# EAGLE board Dragino Pan.v1.7 (EAGLE 7.5.0)
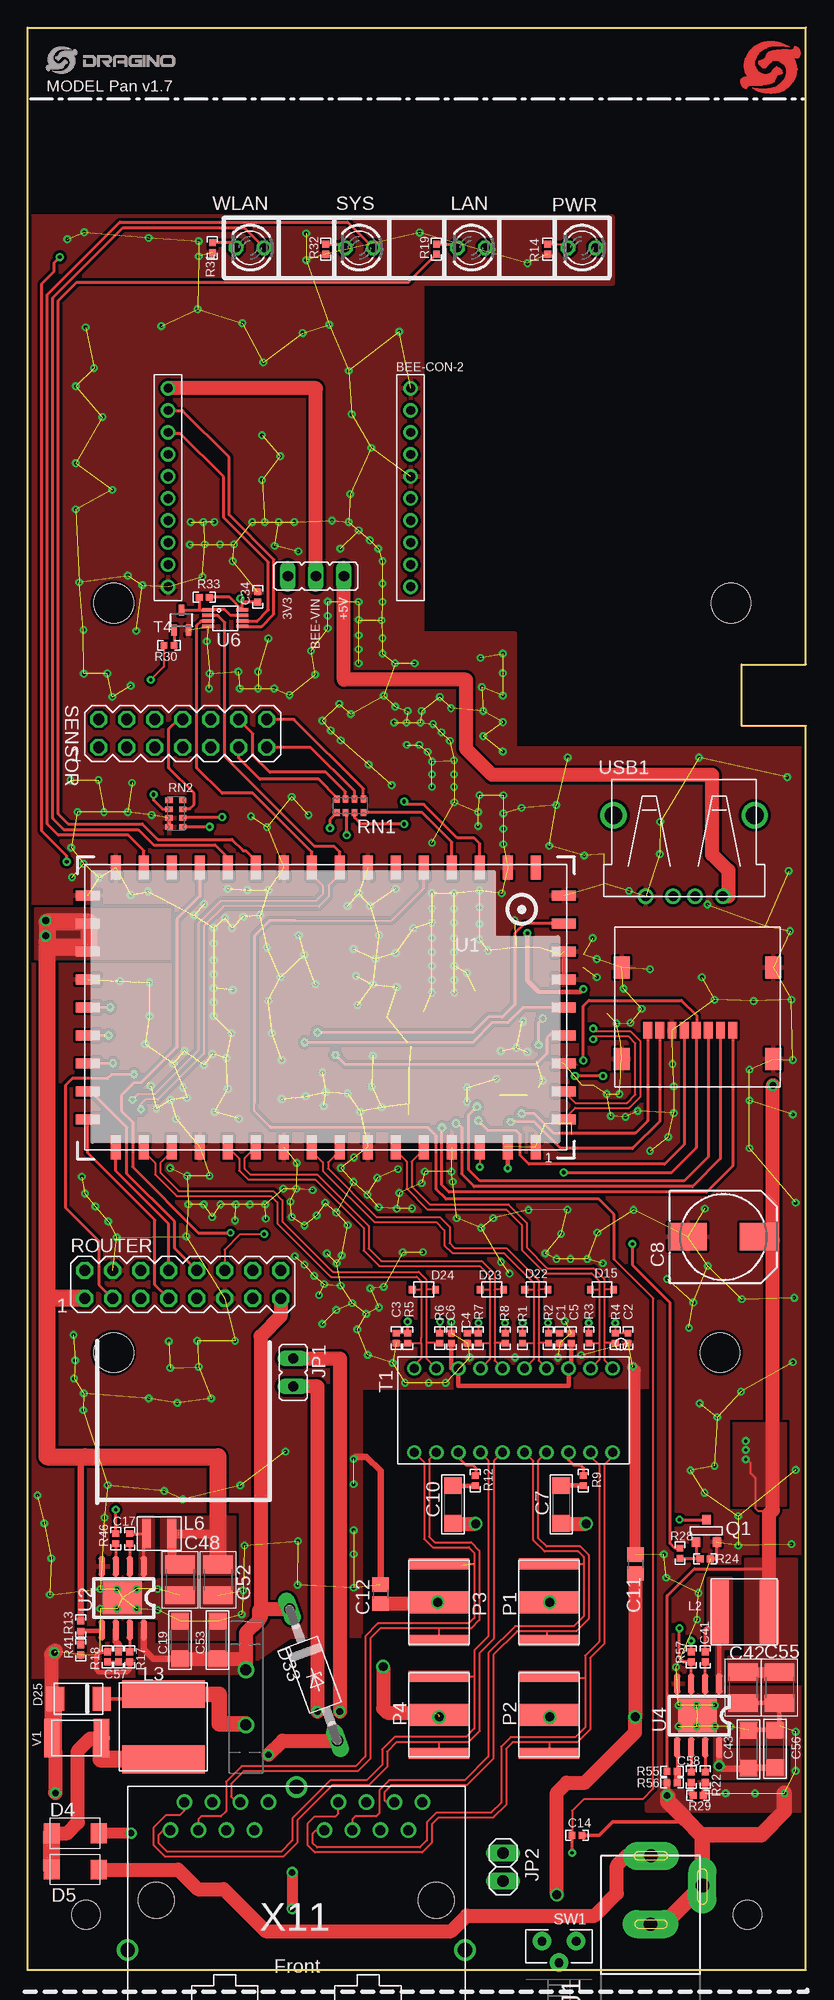
[diagram p6: board, top side]
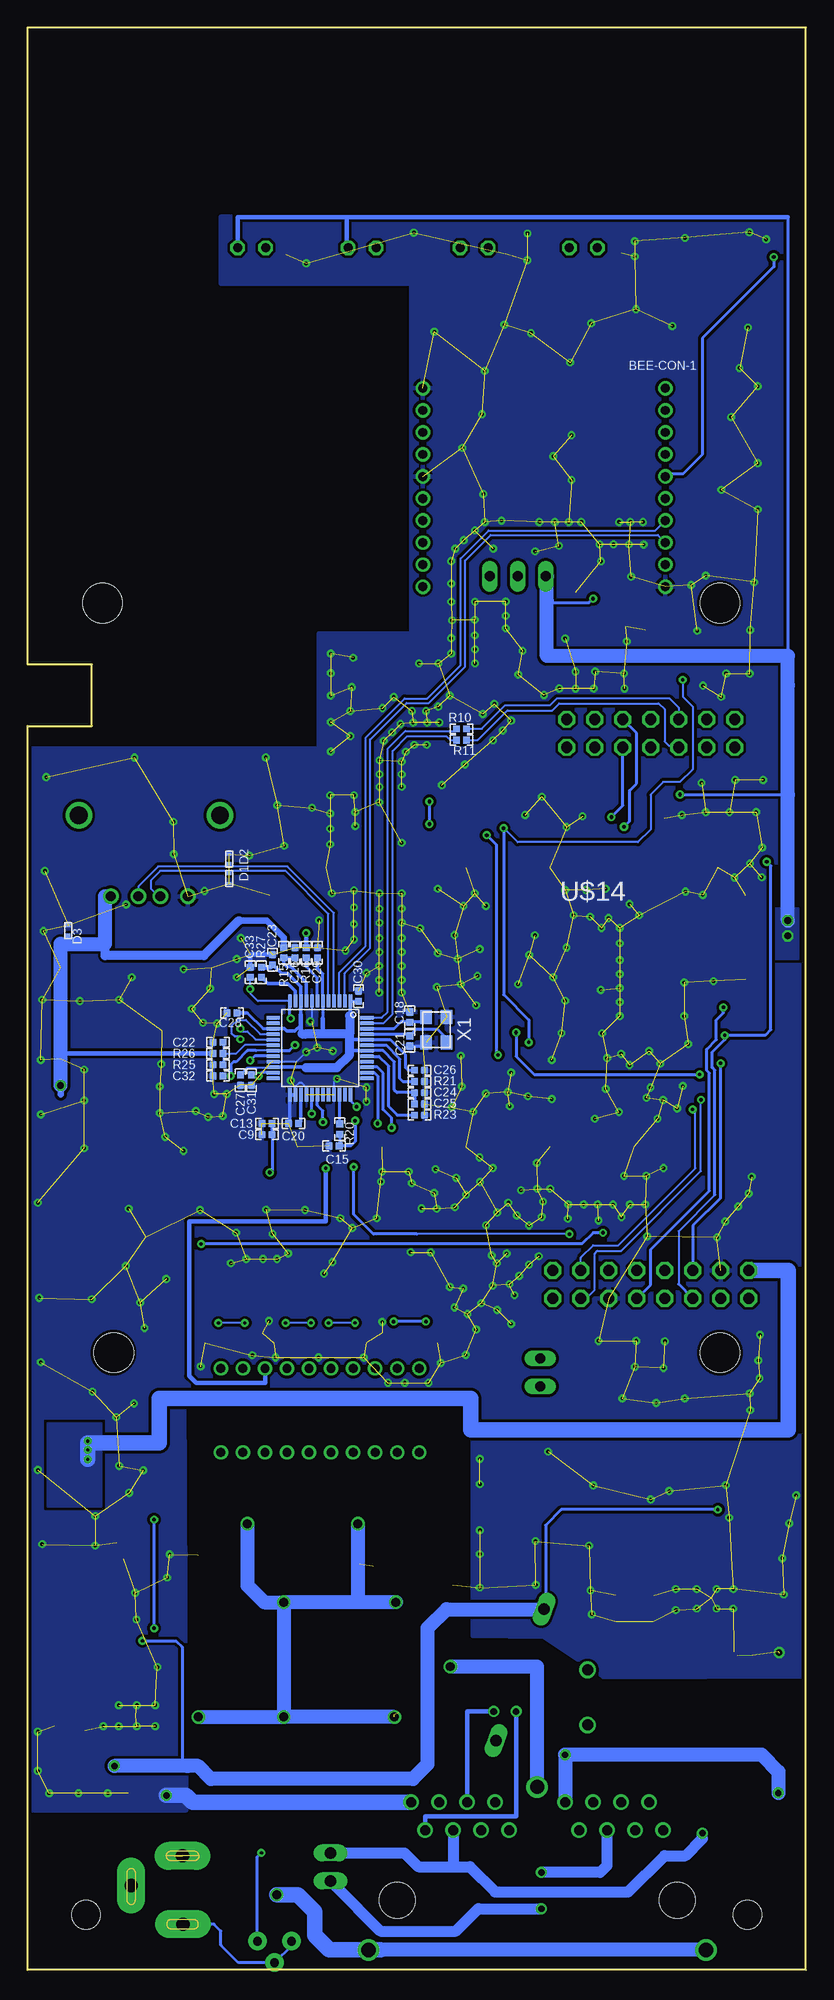
[diagram p7: board, bottom side, seen from below]

Size 70.61 x 176.23 mm. Coordinates in mm from the lower left corner, seen from the top.
Outline: 0,0 70.61,0 70.61,112.86 64.77,112.86 64.77,118.45 70.61,118.45 70.61,176.23 0,176.23 0,0
Copper layers (1*16): Top 0.035mm / dielectric 1.5mm / Bottom 0.035mm
Design rules "default *": minimum track width 8mil, minimum drill 12mil, track to track 8mil, track to pad 8mil, pad to pad 6mil, via to via 8mil, smd to smd 8mil, copper to edge 10mil, drill to drill 8mil, minimum pad ring 10mil, minimum via ring 8mil, stop-mask expansion 1mil, vias tented up to drill 30mil, thermal gap 10mil
Net classes: 0 default: width 0.203 mm, clearance 0.254 mm; 2 gnd: width 0.305 mm, drill 0.33 mm, clearance 0.254 mm; 3 usbvcc: width 0.254 mm, drill 0.61 mm, clearance 0.254 mm; 5 usbtrace: width 0.254 mm, clearance 0.152 mm; 6 usbtrace-4layer: width 0.191 mm, clearance 0.203 mm
Holes 3.6 mm at 62.81,56 7.81,56 63.81,124 7.81,124
Holes 2.6 mm at 65.31,5 5.31,5
tKeepout: area 4.8,53 to 10.8,59; area 59.8,53 to 65.8,59; area 60.8,121 to 66.8,127; area 4.8,121 to 10.8,127

## Footprints (pad centres in the part's own frame; a part is rotated, then mirrored left to right if it is on the bottom)
10P-2.0MM = drill 0.8 pad 1.27: 1 0,9; 2 0,7; 3 0,5; 4 0,3; 5 0,1; 6 0,-1; 7 0,-3; 8 0,-5; 9 0,-7; 10 0,-9
JP2 = drill 0.914 long: 1 -2.54,0; 2 0,0; 3 2.54,0
C0402 = smd 0.61 x 0.61: 1 -0.457,0; 2 0.457,0
C1206 = smd 1.52 x 1.6: 1 -1.71,0; 2 1.71,0
140CLH-0810 = smd 3.5 x 2.5: + 3.25,0; - -3.25,0
C0805 = smd 1.3 x 1.5: 1 -0.85,0; 2 0.85,0
C1210 = smd 1.6 x 2.7: 1 -1.4,0; 2 1.4,0
SOD−923 = smd 0.3 x 0.4: P$1 -0.45,0; P$2 0.45,0
DO214AC = smd 1.45 x 1.8: A 2.13,0; C -2.13,0
SOD−323 = smd 0.6 x 0.7: P$1 -1.05,0; P$2 1.05,0
DO-214AA = smd 1.62 x 2.18: A 2.11,0; C -2.11,0
F126Z12 = drill 1.016 long: A 6.35,0; C -6.35,0
GR72-135 = drill 1: P$1 -2.5,0; P$2 2.5,0
POWER_JACK_SLOT = drill 1.2 pad 2.54 long: GND@1 0,0; GND@2 4.7,3.5; PWR 0.04,6.2
JP1 = drill 0.914 long: 1 0,-1.27; 2 0,1.27
1X02 = drill 1.016 long: 1 -1.27,0; 2 1.27,0
SWPA6028S = smd 5.7 x 1.7: P$1 0,2.25; P$2 0,-2.25
LVS808040 = smd 2.5 x 7.5: P$1 -2.95,0; P$2 2.95,0
SWPA3010S = smd 0.8 x 2.7: P$1 -1.15,0; P$2 1.15,0
LED3MM = drill 0.813 octagon: A -1.27,0; K 1.27,0
GDT-LT-B3D090L = smd 1 x 5.5: 1 -3.48,0; 3 3.48,0 | smd 2 x 5.5: 2 0,0
SOT-23 = smd 0.787 x 0.889: 1 0,-1.016; 2 -0.95,1.016; 3 0.95,1.016
R0402 = smd 0.61 x 0.61: 1 -0.457,0; 2 0.457,0
0603-ARC = smd 0.5 x 0.65: 1 -1.2,-0.625; 2 -0.4,-0.625; 3 0.4,-0.625; 4 1.2,-0.625; 5 1.2,0.625; 6 0.4,0.625; 7 -0.4,0.625; 8 -1.2,0.625
MA08-2 = drill 1.016 octagon: 1 -8.89,-1.27; 2 -8.89,1.27; 3 -6.35,-1.27; 4 -6.35,1.27; 5 -3.81,-1.27; 6 -3.81,1.27; 7 -1.27,-1.27; 8 -1.27,1.27; 9 1.27,-1.27; 10 1.27,1.27; 11 3.81,-1.27; 12 3.81,1.27; 13 6.35,-1.27; 14 6.35,1.27; 15 8.89,-1.27; 16 8.89,1.27
MA07-2 = drill 1.016 octagon: 1 -7.62,-1.27; 2 -7.62,1.27; 3 -5.08,-1.27; 4 -5.08,1.27; 5 -2.54,-1.27; 6 -2.54,1.27; 7 0,-1.27; 8 0,1.27; 9 2.54,-1.27; 10 2.54,1.27; 11 5.08,-1.27; 12 5.08,1.27; 13 7.62,-1.27; 14 7.62,1.27
TS-026 = drill 0.8 pad 1.676: 1 -1.55,-0.975; 2 1.55,-0.975; 3 0,0.975
RIONET_H2038 = drill 0.8: 1 -3.81,9; 2 -3.81,7; 3 -3.81,5; 4 -3.81,3; 5 -3.81,1; 6 -3.81,-1; 7 -3.81,-3; 8 -3.81,-5; 9 -3.81,-7; 10 -3.81,-9; 11 3.81,-9; 12 3.81,-7; 13 3.81,-5; 14 3.81,-3; 15 3.81,-1; 16 3.81,1; 17 3.81,3; 18 3.81,5; 19 3.81,7; 20 3.81,9
SOT323 = smd 0.5 x 1: 1 0,0.9; 2 -0.65,-0.9; 3 0.65,-0.9
HE50 = smd 0.9 x 2.198: 1 -19.05,12.69; 2 -16.51,12.69; 3 -13.97,12.69; 4 -11.43,12.69; 5 -8.89,12.69; 6 -6.35,12.69; 7 -3.81,12.69; 8 -1.27,12.69; 9 1.27,12.69; 10 3.81,12.69; 11 6.35,12.69; 12 8.89,12.69; 13 11.43,12.69; 14 13.97,12.69; 15 16.51,12.69; 16 19.05,12.69; 26 19.05,-12.69; 27 16.51,-12.69; 28 13.97,-12.69; 29 11.43,-12.69; 30 8.89,-12.69; 31 6.35,-12.69; 32 3.81,-12.69; 33 1.27,-12.69; 34 -1.27,-12.69; 35 -3.81,-12.69; 36 -6.35,-12.69; 37 -8.89,-12.69; 38 -11.43,-12.69; 39 -13.97,-12.69; 40 -16.51,-12.69; 41 -19.05,-12.69 | smd 2.198 x 0.9: 17 21.579,10.16; 18 21.579,7.62; 19 21.579,5.08; 20 21.579,2.54; 21 21.579,0; 22 21.579,-2.54; 23 21.579,-5.08; 24 21.579,-7.62; 25 21.579,-10.16; 42 -21.579,-10.16; 43 -21.579,-7.62; 44 -21.579,-5.08; 45 -21.579,-2.54; 46 -21.579,0; 47 -21.579,2.54; 48 -21.579,5.08; 49 -21.579,7.62; 50 -21.579,10.16
RT8250-SOP8 = smd 1.88 x 0.61: 1 -1.219,0; 2 -1.219,-1.27; 3 -1.219,-2.54; 4 -1.219,-3.81; 5 4.547,-3.81; 6 4.547,-2.54; 7 4.547,-1.27; 8 4.547,0 | smd 2.997 x 3.505: 9 1.651,-1.956
AU6350_LQFP-48 = smd 1.2 x 0.3: 1 -4.25,2.75; 2 -4.25,2.25; 3 -4.25,1.75; 4 -4.25,1.25; 5 -4.25,0.75; 6 -4.25,0.25; 7 -4.25,-0.25; 8 -4.25,-0.75; 9 -4.25,-1.25; 10 -4.25,-1.75; 11 -4.25,-2.25; 12 -4.25,-2.75; 25 4.25,-2.75; 26 4.25,-2.25; 27 4.25,-1.75; 28 4.25,-1.25; 29 4.25,-0.75; 30 4.25,-0.25; 31 4.25,0.25; 32 4.25,0.75; 33 4.25,1.25; 34 4.25,1.75; 35 4.25,2.25; 36 4.25,2.75 | smd 0.3 x 1.2: 13 -2.75,-4.25; 14 -2.25,-4.25; 15 -1.75,-4.25; 16 -1.25,-4.25; 17 -0.75,-4.25; 18 -0.25,-4.25; 19 0.25,-4.25; 20 0.75,-4.25; 21 1.25,-4.25; 22 1.75,-4.25; 23 2.25,-4.25; 24 2.75,-4.25; 37 2.75,4.25; 38 2.25,4.25; 39 1.75,4.25; 40 1.25,4.25; 41 0.75,4.25; 42 0.25,4.25; 43 -0.25,4.25; 44 -0.75,4.25; 45 -1.25,4.25; 46 -1.75,4.25; 47 -2.25,4.25; 48 -2.75,4.25
US8 = smd 0.3 x 1.1: 1 -0.75,-1.55; 2 -0.25,-1.55; 3 0.25,-1.55; 4 0.75,-1.55; 5 0.75,1.55; 6 0.25,1.55; 7 -0.25,1.55; 8 -0.75,1.55
RIONET_472192001_SD = smd 0.8 x 1.5: 1 3.2,-1.55; 2 2.1,-1.55; 3 1,-1.55; 4 -0.1,-1.55; 5 -1.2,-1.55; 6 -2.3,-1.55; 7 -3.4,-1.55; 8 -4.5,-1.55 | smd 1.45 x 2: G1 6.875,-4.15; G2 6.875,4.15; G3 -6.875,4.15; G4 -6.875,-4.15
USB_C42562 = drill 0.9: 1 -3.5,5.29; 2 -1,5.29; 3 1,5.29; 4 3.5,5.29 | drill 1.6: P$1 -6.4,-2.06; P$2 6.4,-2.06
BC301N-D = smd 1.4 x 3.5: P$1 -2.25,0; P$2 2.25,0
SMARTPRJ_CRYSTAL-3.2-2.5 = smd 1.3 x 1.05: 1 -1.15,-0.925; 2 1.15,-0.925; 3 1.15,0.925; 4 -1.15,0.925
EHERNET-1X2-PLASTIC1 = drill 0.9: 1-1 2.54,-7.49; 1-2 3.81,-4.95; 1-3 5.08,-7.49; 1-4 6.35,-4.95; 1-5 7.62,-7.49; 1-6 8.89,-4.95; 1-7 10.16,-7.49; 1-8 11.43,-4.95; 2-1 -11.43,-7.49; 2-2 -10.16,-4.95; 2-3 -8.89,-7.49; 2-4 -7.62,-4.95; 2-5 -6.35,-7.49; 2-6 -5.08,-4.95; 2-7 -3.81,-7.49; 2-8 -2.54,-4.95 | drill 1.3: P$1 0,-8.89; P$2 -15.3,5.9; P$3 15.3,5.9 | hole 3.25: -12.7,1.4; 12.7,1.4

## Placement (x,y rotation side)
BEE-CON-1  BEE-1  [10P-2.0MM]  12.75,134.5 0 top
BEE-CON-2  BEE-1  [10P-2.0MM]  34.75,134.5 0 top
BEE-VIN  1x3 , 2.54 弯针  [JP2]  26.16,126.45 0 top
C1  0.1uF  [C0402]  48.29,57.32 270 top
C2  0.1uF  [C0402]  54.47,57.32 270 top
C3  0.1uF  [C0402]  33.45,57.32 270 top
C4  0.1uF  [C0402]  39.87,57.32 270 top
C5  0.1uF  [C0402]  49.33,57.32 90 top
C6  0.1uF  [C0402]  38.45,57.32 90 top
C7  1000pF 2kv  [C1206]  48.42,42.23 270 top
C8  470uF 10v  [140CLH-0810]  63.12,66.5 0 top
C9  0.1uF  [C0402]  48.89,75.78 180 bottom
C10  1000pF 2kv  [C1206]  38.58,42.23 270 top
C11  0.1uF,100V  [C0805]  55.15,36.83 270 top
C12  0.1uF,100V  [C0805]  32.04,34.09 270 top
C13  1uF  [C0402]  48.89,76.79 180 bottom
C14  1pf  [C0402]  49.84,12.2 0 top
C15  10pf,NL  [C0402]  42.8,74.76 180 bottom
C16  2.2uF  [C0402]  46.35,92.29 90 bottom
C17  0.1u,50v  [C0402]  9.27,39.12 90 top
C18  18pF  [C0402]  35.94,86.44 90 bottom
C19  10uf,50v  [C1206]  13.84,29.93 90 top
C20  1uF  [C0402]  46.48,76.79 180 bottom
C21  18pF  [C0402]  35.94,84.28 270 bottom
C22  1uF  [C0402]  53.34,84.16 180 bottom
C23  4.7uF  [C0402]  48.39,91.65 90 bottom
C24  4.7uF  [C0402]  35.05,79.59 0 bottom
C25  1uF  [C0402]  35.05,78.57 0 bottom
C26  4.7uF  [C0402]  35.05,81.62 0 bottom
C27  0.1uF  [C0402]  51.31,80.73 270 bottom
C28  0.1uF  [C0402]  52.07,86.83 180 bottom
C29  0.1uF  [C0402]  44.32,92.29 90 bottom
C30  0.1uF  [C0402]  40.59,88.35 90 bottom
C31  4.7uF  [C0402]  50.29,80.73 270 bottom
C32  4.7uF  [C0402]  53.34,81.11 180 bottom
C33  0.1uF  [C0402]  50.42,90.51 90 bottom
C34  0.1u  [C0402]  20.88,124.57 90 top
C41  0.1u,50v  [C0402]  61.47,28.41 90 top
C42  22uf,10v  [C1210]  64.9,25.61 270 top
C43  10uf,50v  [C1206]  65.41,20.02 90 top
C48  22uF,10v  [C1210]  13.82,35.39 270 top
C52  22uF,10v  [C1210]  17.27,35.39 270 top
C53  10uf,50v  [C1206]  17.25,29.93 90 top
C55  22fu,10v  [C1210]  68.2,25.61 270 top
C56  10uf,50v  [C1206]  67.82,20.05 90 top
C57  2.7nf  [C0402]  8.25,28.41 90 top
C58  2.7nf  [C0402]  60.2,17.48 90 top
D1  ESD7951ST5G  [SOD−923]  52.32,99.02 270 bottom
D2  ESD7951ST5G  [SOD−923]  52.32,100.8 90 bottom
D3  ESD7951ST5G  [SOD−923]  66.93,94.32 90 bottom
D4  STPS1L30  [DO214AC]  4.32,12.4 0 top
D5  STPS1L30  [DO214AC]  4.32,9.1 0 top
D15  BS05C  [SOD−323]  52.11,61.72 0 top
D22  BS05C  [SOD−323]  46.15,61.72 0 top
D23  BS05C  [SOD−323]  42.11,61.72 0 top
D24  BS05C  [SOD−323]  35.94,61.72 0 top
D25  SMBJ43A  [DO-214AA]  4.61,24.59 180 top
D33  1N4001  [F126Z12]  25.94,26.77 290 top
F2  GRD-GR72-135 1.35A  [GR72-135]  19.81,24.72 90 top
J1  POWER_JACKSLT  [POWER_JACK_SLOT]  56.52,4.15 0 top
JP1  [JP1]  24.11,54.2 180 top
JP2  [1X02]  43.13,9.33 270 top
L2  6.8uH / SWPA6045S6R8MT  [SWPA6028S]  65.02,32.47 90 top
L3  100uH, 1.4A, LVS808040-101  [LVS808040]  12.32,22.06 90 top
L6  4.7uH /SWPA3015S4R7MT  [SWPA3010S]  11.94,39.58 0 top
LAN  [LED3MM]  40.26,156.25 180 top
P1  3R420L  [GDT-LT-B3D090L]  47.31,33.36 270 top
P2  3R420L  [GDT-LT-B3D090L]  47.31,23.14 270 top
P3  3R420L  [GDT-LT-B3D090L]  37.34,33.36 270 top
P4  3R420L  [GDT-LT-B3D090L]  37.34,23.14 270 top
PWR  [LED3MM]  50.29,156.25 180 top
Q1  BSS138-7-F  [SOT-23]  61.59,39.84 180 top
R1  49.9  [R0402]  44.91,57.32 270 top
R2  49.9  [R0402]  47.24,57.32 270 top
R3  49.9  [R0402]  50.92,57.32 270 top
R4  49.9  [R0402]  53.31,57.32 270 top
R5  49.9  [R0402]  34.49,57.32 270 top
R6  49.9  [R0402]  37.38,57.32 270 top
R7  49.9  [R0402]  40.89,57.32 270 top
R8  49.9  [R0402]  43.33,57.32 270 top
R9  75  [R0402]  50.41,44.4 90 top
R10  330,NL  [R0402]  31.24,112.61 180 bottom
R11  330, NL  [R0402]  31.24,111.59 0 bottom
R12  75  [R0402]  40.61,44.39 90 top
R13  75K 1%  [R0402]  4.83,31.2 90 top
R14  330  [R0402]  47.18,156.13 90 top
R15  0R  [R0402]  47.37,92.29 270 bottom
R16  0R  [R0402]  45.34,92.29 270 bottom
R17  180K  [R0402]  9.27,28.41 270 top
R18  16K 1%  [R0402]  7.24,28.41 270 top
R19  330  [R0402]  37.08,156.13 90 top
R20  0R  [R0402]  42.29,76.28 270 bottom
R21  680  [R0402]  35.05,80.6 180 bottom
R22  180K  [R0402]  61.47,17.48 270 top
R23  330  [R0402]  35.05,77.55 0 bottom
R24  47K,NL  [R0402]  61.47,37.3 180 top
R25  470K  [R0402]  53.34,82.13 180 bottom
R26  47K  [R0402]  53.34,83.14 180 bottom
R27  0R  [R0402]  49.4,90.51 270 bottom
R28  4.7k  [R0402]  59.18,37.8 270 top
R29  24K  [R0402]  60.83,15.83 0 top
R30  4.7K  [R0402]  12.83,120.18 180 top
R31  330  [R0402]  16.76,156.25 90 top
R32  330  [R0402]  27.05,156.13 90 top
R33  100K  [R0402]  16.03,124.54 0 top
R41  24K 1%  [R0402]  4.83,29.04 90 top
R46  100K  [R0402]  8,39.12 270 top
R55  53.6K 1%  [R0402]  58.47,18.02 180 top
R56  10K 1%  [R0402]  58.47,16.97 0 top
R57  100K  [R0402]  60.2,28.41 90 top
RN1  4D02WGJ0000TCE 0ohm , NL  [0603-ARC]  29.26,105.62 0 top
RN2  4D02WGJ0000TCE 0ohm , NL  [0603-ARC]  13.46,104.91 270 top
ROUTER  [MA08-2]  14.07,62.19 0 top
SENSOR  [MA07-2]  14.07,112.19 0 top
SW1  TS-026  [TS-026]  48.21,1.62 180 top
SYS  [LED3MM]  30.1,156.25 180 top
T1  RJ45_TRANSFORMER_HST2038DR  [RIONET_H2038]  44.08,50.76 270 top
T4  2SC4081/SC70  [SOT323]  13.94,122.46 0 top
U1  HE  [HE50]  27.05,87.33 180 top
U2  RT7272  [RT8250-SOP8]  10.54,35.39 270 top
U3  AU6353  [AU6350_LQFP-48]  44.07,83.65 270 bottom
U4  RT7272  [RT8250-SOP8]  62.74,24.72 270 top
U6  NC7WZ125  [US8]  17.93,122.64 270 top
U$3  LOGO-NEW  [LOGO-SILK-NEW]  1.67,172.05 0 top
U$7  [DRGAINO_LOGO_STOP]  64.51,170.07 0 top
U$14  [RIONET_472192001_SD]  60.76,86.8 0 top
USB1  USB_C42562  [USB_C42562]  59.56,102.7 180 top
V1  BC301N-D  [BC301N-D]  4.44,21.04 0 top
WLAN  [LED3MM]  20.19,156.25 180 top
X1  12Mhz  [SMARTPRJ_CRYSTAL-3.2-2.5]  33.53,85.3 270 bottom
X11  EHERNET-1X2-PLASTIC  [EHERNET-1X2-PLASTIC1]  24.38,7.72 180 top

## Tracks (layer width: path | path; a pad name or v marks a point on that pad's centre or on a via)
2.0V_CTL  (via drill 0.3)
  Top 0.406: U1.2 v43.56,72.73 | C6.1 38.45,54.57 T1.8 39.08,52.99 49.07,52.99 T1.3 49.33,54.82 C5.1
  Top 0.508: 43.56,74.78 U1.2
  Bottom 0.406: v43.56,72.73 43.56,67.93 55.96,67.93 55.96,53.88 55.32,53.25 49.07,53.25 T1.3
+3V3  (via drill 0.33, 0.6)
  Top 0.203: 2.29,50.25 2.29,48.98 1.78,48.98
  Top 0.254: 20.95,124.04 C34.1 19.61,124.11 v19.3,124.42 19.48,124.24 U6.8 18.33,124.54 R33.2 | v11.43,106.64 11.43,106.13 12.25,105.31 RN2.2
  Top 0.61: R13.2 4.83,46.16 5.23,46.57
  Top 0.813: C48.1 13.74,36.71 13.28,36.71 13.09,36.91 L6.P$2 17.27,39.58
  Top 1.524: 1.78,60.92 1.78,48.98 1.78,46.57 5.23,46.57 17.27,46.57 17.27,39.58 C52.1 | ROUTER.1 1.78,60.92 | 1.78,60.92 1.78,92.79 5.59,92.79 5.59,94.44 5.6,94.44 5.6,95.06 1.78,95.06 1.78,93.3
  Bottom 0.254: 1.65,159.05 1.65,119.21 | v11.43,106.64 1.65,106.64 | 23.49,124.16 23.37,124.04 19.68,124.04 v19.3,124.42
  Bottom 0.406: PWR.A 51.56,159.05 41.66,159.05 | LAN.A 41.66,156.25 41.66,159.05 | 1.65,159.05 41.66,159.05 | 1.65,116.54 1.65,107.91 1.78,107.78
  Bottom 1.27: v1.65,95.21 1.65,106.64 1.65,116.54 1.65,119.21 23.49,119.21 23.49,124.16 23.49,126.45 BEE-VIN.1
  other vias: 1.65,93.81
  pour Top (isolate 0.254, no thermals): 0.63,96.35 12.95,96.35 12.95,91.65 0.63,91.65
  pour Bottom (no thermals): 0.63,96.35 12.95,96.35 12.95,91.65 0.63,91.65
  pour Top (isolate 0.305, no thermals): 18.8,35.9 12.19,35.9 12.19,41.1 18.8,41.1
+5V  (via drill 0.3, 0.6)
  Top 0.203: 67.61,41.72 67.56,41.66 66.22,41.66 65.99,41.89 65.99,44.64 65.58,45.04 65.58,45.96 65.36,46.17 65.29,46.17 v65.15,46.31
  Top 0.254: R55.2 58.01,33.94 60.48,36.41 67.27,36.41
  Top 1.016: C42.1 C55.1
  Top 1.27: 67.61,41.72 67.61,66.23 | 67.61,66.23 v67.61,80.25 | 67.56,41.66 67.27,41.37 67.27,36.41 L2.P$2 | C8.+ 67.34,66.5 67.61,66.23 | USB1.1 63.57,97.41 63.57,99.78 63.5,99.78 62.1,101.18 62.1,108.41 42.16,108.41 39.75,110.83 39.75,117.05 28.7,117.05 BEE-VIN.3
  Bottom 0.305: D3.P$1 66.93,93.1
  Bottom 0.406: R26.2 67.61,83.14
  Bottom 0.61: 67.61,79.43 67.61,80.75 | R15.1 47.37,93.68 48.89,95.21 51.44,95.21
  Bottom 0.813: 51.44,95.21 54.61,92.03 63.57,92.03 63.57,93.81
  Bottom 1.016: v65.15,47.18 v65.15,47.99
  Bottom 1.27: v67.61,80.25 67.61,80.75 67.61,83.14 67.61,93.1 66.93,93.1 63.57,93.1 63.57,93.81 63.57,97.41 USB1.1
  Bottom 1.422: ROUTER.2 1.63,63.46 1.63,48.98 30.43,48.98 30.43,51.85 58.65,51.85 58.65,47.81 65.15,47.81 v65.15,47.18 v65.15,46.31
  pour Bottom (no thermals): 63.88,49.61 63.88,41.99 68.83,41.99 68.83,49.61
  pour Top (no thermals): 64.01,49.61 64.01,42.12 68.83,42.12 68.83,49.61
  pour Top (isolate 0.254, no thermals): 69.72,26.12 63.63,26.12 63.63,28.41 65.15,28.41 65.15,37.3 69.72,37.3
/BEE_OE
  Top 0.254: 13.93,123.35 T4.1 15.49,123.36 | 15.49,123.36 16.35,123.36 U6.1 16.39,123.4 17.91,123.4 18.42,122.89 U6.7 | R33.1 15.57,123.44 15.49,123.36
/RESET  (via drill 0.3, 0.33)
  Top 0.254: v9.65,81.24 7.62,81.24 7.24,80.86 4.06,80.86 3.43,80.22 3.43,69.17 6.48,66.12 6.48,62.16 ROUTER.3 | U1.43 45.08,94.95 44.2,94.06 44.2,87.59 43.05,86.44 41.78,86.44 40.39,85.05 v26.29,85.05
  Bottom 0.254: v26.29,85.05 26.29,82.89 24.64,81.24 v9.65,81.24
BEE-RXD
  Top 0.254: U6.6 20.83,122.39 21.84,123.4 21.84,127.72 17.78,131.78 17.78,135.47 13.84,139.4 12.85,139.4 BEE-CON-1.3
BEE-TXD
  Top 0.254: U6.5 21.22,121.89 22.35,123.02 22.35,127.97 18.29,132.04 18.29,137.24 14.1,141.44 12.82,141.44 BEE-CON-1.2
BEE-VIN
  Top 1.27: BEE-VIN.2 26.16,143.5 BEE-CON-1.1
CHIP_RESETN
  Bottom 0.203: U3.18 50.93,83.9 51.69,83.14 R26.1 | C22.1 R26.1 | R26.1 R25.1
CPWR_V33  (via drill 0.33)
  Top 0.254: v50.42,82.51 50.42,87.46 50.93,87.97 59.31,87.97 60.71,86.57 60.71,85.3 U$14.4 60.66,74.58 58.42,72.35 v48.64,72.35
  Bottom 0.254: U3.20 50.03,82.9 v50.42,82.51 | C13.1 48.44,72.55 v48.64,72.35
  Bottom 0.305: C13.1 C9.1
DC-VIN  (1 unrouted)
  Top 1.27: D5.A 13.66,9.1 15.44,7.32 17.78,7.32 21.59,3.51 38.43,3.51 39.83,4.91 51.44,4.91 53.47,6.94 53.47,9.48 54.36,10.37 57.29,10.37
GND  (via drill 0.3, 0.58, 0.6)  (535 unrouted)
  Top 0.203: 2.16,19.9 2.2,19.9 V1.P$1
  Top 0.254: R24.1 62.33,37.3 62.53,37.5 62.53,38.81 Q1.2 | RN2.3 RN2.4
  Top 0.305: D25.A 2.86,24.59 2.2,25.25 | C14.2 51.87,12.2 53.09,13.42 59.56,13.42 59.75,13.61
  Top 0.406: V1.P$1 2.29,20.95 | R17.2 9.27,27.26 9.02,27.01 6.48,27.01 6.22,27.26 6.22,28.53 6.55,28.86 R18.1 | C42.2 C55.2 68.2,22.14 C56.2 65.43,21.76 C43.2 | U1.44 U1.45
  Top 0.61: R22.2 61.47,16.01 R29.2 | R56.1 v58.01,15.83 | C12.1 32.04,45.26 30.73,46.57 29.78,46.57 v29.58,46.36
  Top 1.016: C11.1 55.15,54.41 54.86,54.69
  Top 1.27: 2.2,28.61 2.16,28.61 2.16,19.9 2.5,19.9 | 2.5,19.9 D25.A | 2.5,19.9 2.5,16.07 v2.52,16.06 | 58.09,15.76 v58.01,15.83 | v21.84,19.52 23.13,20.8 D33.A
  Top 1.422: 2.2,28.61 2.5,28.91 | 58.09,15.76 58.09,15.27 59.75,13.61 61.09,12.28 | 61.09,12.28 61.21,12.15 J1.GND@2 57.71,4.15 J1.GND@1 | v68.66,16.02 68.66,14.39 66.55,12.28 61.09,12.28
  Bottom 0.203: C15.2 43.31,74.76 | v42.54,80.86 42.82,80.58 U3.33 | U3.28 45.32,80.07 45.72,80.47 45.97,80.47 46.35,80.09 46.35,79.44 U3.26 | U3.8 44.82,86.06 v44.96,86.06 | U3.21 46.21,82.4 v45.34,83.27
  Bottom 0.254: C21.2 34.78,83.83 X1.2 | SW1.2 46.66,2.2 SW1.3 51.49,0.65 53.09,2.24 53.09,3.51 53.72,4.15 J1.GND@1
  Bottom 0.305: 46.35,79.44 46.39,79.4 U3.25 46.82,76.91 C20.2
  Bottom 0.406: C23.2 50.42,92.11 C33.2
  Bottom 1.27: X11.1-1 v21.84,19.52 4.03,19.52 2.5,17.99 2.5,16.07 v2.52,16.06 | X11.2-1
  Bottom 1.422: X11.2-1 55.63,15.2 56.26,15.83 v58.01,15.83
  other vias: 2.44,28.79 12.8,57.03 15.39,57.08 15.52,54.72 12.93,54.62 5.11,52.31 5.05,50.78 4.22,53.65 4.32,55.3 4.17,57.62 8.08,66.45 7.32,67.9 6.15,69.27 5.21,70.44 4.93,71.97 26.44,61.22 28.02,59.88 29.92,58.1 29.44,60.5 26.75,58.61 30.71,59.52 36.04,72.42 52.91,77.48 31.72,71.86 32.13,78.27 14.48,72.04 16.51,72.04 44.17,95.23 55.35,77.94 5.08,100.37 4.02,99.13 33.35,114.61 25.27,155.13 15.52,156.85 62.56,50.15 60.96,51.39 31.88,60.1 42.95,64.22 51.69,66.89 41.15,67.32 34.04,65.11 28.5,64.83 21.62,68.16 18.82,68 16.66,51.85 11,51.85 0.9,43.05 12.4,43.45 60.4,60.55 64.8,60.85 60,58.25 14.47,79.13 16.97,77.83 18.17,79.93 19.17,77.23 13.47,77.23 42.92,83.37 44.34,83.68 9.37,97.53 3.97,101.83 9.86,121.5 5.07,121.58 5.11,117.61 27.23,124.15 21.85,120.8 23.77,115.68 22.37,116.26 35.57,157.63 25.27,157.55 15.53,155.47 30.86,55.79 40.12,55.57 38.44,58.78 32.32,61.98 33.12,55.07 35.86,65.11 43.72,63.18 44.22,55.57 48.12,55.57 48.72,58.87 50.22,55.77 48.39,66.78 53.68,79.46 58.02,62.68 14.4,66.56 33.26,113.18 57.72,37.7 30.05,122.49 54.56,97.9 56.46,90.79 46.73,80.69 39.87,78.78 39.87,80.05 54.92,54.76 61.4,43.29 60.13,45.32 31.23,80.15 8.38,89.7 18.04,82.73 16.9,90.35 18.17,98.09 10.93,97.84 31.88,93.89 29.59,92.62 16.51,117.62 7.24,117.62 57.94,35.59 58.83,27.47 60.86,34.2 60.73,31.78 7.26,43.98 23.39,47.02 24.54,38.9 63.33,16.02 65.99,16.02 69.68,18.05 69.68,21.61 64.47,38.5 64.47,41.16 69.29,38.62 69.68,45.35 62.31,45.74 64.72,52.47 69.55,60.98 69.42,55.13 69.68,69.61 58.63,77.74 58.63,80.15 56.47,74.31 48.97,68.98 58.12,75.58 65.48,78.88 69.42,77.61 62.31,88.03 58.5,82.18 65.87,87.9 65.48,81.68 69.42,82.57 69.29,88.03 69.17,94.25 68.91,108.22 69.04,99.71 60.91,110 47.96,105.68 57.36,101.23 61.67,96.66 50.5,101.11 47.32,102 43.01,97.68 38.69,97.68 38.69,92.34 54.05,89.04 51.64,91.71 53.42,85.87 31.32,82.95 27.04,79.64 24.37,70.88 29.58,44.08 29.58,39.89 29.58,37.73 29.58,34.68 24.5,34.93 19.42,32.27 19.67,38.49 19.29,43.95 6.97,41.03 14.09,42.68 1.51,40.52 2.02,34.05 13.58,51.44 18.82,57.08 24.41,73.21 29.62,73.72 10.67,84 11.06,89.59 16.9,89.08 21.85,87.93 21.72,92.76 33.41,92.25 33.41,98.09 21.85,97.97 18.55,94.54 11.06,86.54 6.48,99.11 21.72,103.68 33.03,107.49 29.32,113.94 38.72,105.94 43.16,106.57 44.81,105.43 49,110 57.39,104.16 32.11,122.45 30.05,121.09 28.27,114.87 7.7,115.5 9.35,116.52 16.46,116.26 19.13,117.79 19.25,116.26 4.69,125.89 10.4,125.64 14.72,129.32 15.87,126.4 4.38,136.7 4.38,132.51 4.38,143.69 18.6,127.81 3.61,157.02 5.14,157.66 10.98,157.15 30.03,124.13 43.11,117.65 38.46,72.42 34.4,111.15 35.54,111.15 36.3,110.51 36.68,109.62 36.68,108.48 36.68,107.34 36.68,102.26 36.68,97.68 36.68,96.29 36.68,95.02 36.68,93.62 36.68,92.35 36.68,91.08 36.68,89.81 36.68,88.67 38.72,88.67 38.72,89.81 38.72,91.08 38.69,93.61 38.69,95.01 38.69,96.28 38.69,107.33 38.69,108.47 38.69,109.74 38.31,111.52 37.54,112.28 36.78,113.05 35.64,113.17 34.37,113.17 27.24,121.71 27.24,122.86 24.57,128.7 32.19,124.13 32.19,125.78 28.38,128.95 35.75,114.22 32.32,115.62 43.11,119.43 32.19,120.83 32.19,119.43 41.33,114.22 43.11,115.62 41.33,111.94 43.11,113.21 43.11,110.54 41,106.57 40.88,105.05 43.16,104.92 40.88,103.78 43.16,103.53 43.16,102.13 41,97.94 41,96.41 41,94.89 41,93.49 41.76,92.48 39.86,90.45 19.95,97.97 16.01,96.7 15.12,95.68 16.9,91.62 17.91,95.43 16.9,94.54 16.9,93.14 19.56,95.55 21.09,95.68 16.9,87.81 16.9,86.54 16.77,83.11 16.01,82.09 14.1,80.06 11.18,80.19 13.21,82.22 14.23,83.36 11.69,78.16 12.96,78.92 54.24,77.39 38.94,68.21 42.24,68.21 33.6,72.65 65.48,74.56 33.73,70.49 34.87,69.1 35.76,71.38 26.87,78.37 38.56,71.51 25.86,70.75 26.24,68.46 27,69.6 28.02,68.71 29.03,67.57 23.19,70.87 52.54,79.46 54.7,85.93 55.72,87.2 28.42,72.75 54.97,68.94 29.57,71.48 30.84,70.34 31.85,69.2 33.5,69.07 23.85,69.71 23.98,68.31 27.15,65.01 12.93,72.75 14.58,69.45 15.98,69.45 16.74,68.31 17.5,69.45 18.9,69.45 20.17,69.45 21.56,69.45 25.12,67.55 24.23,64.75 25.12,63.99 28.04,64.12 26.01,62.97 26.9,62.21 28.42,62.09 31.09,61.83 45.44,68.94 46.96,65.01 47.98,64.5 49.25,64.5 50.77,64.5 52.17,64.12 61.44,69.07 61.7,63.86 61.17,90.06 51.64,90.06 51.26,93.61 23.07,79.01 30.18,77.87 25.1,92.09 26.11,89.42 31.32,89.42 20.27,104.66 9.1,126.51 45.35,154.84 30.03,119.81 30.03,118.54 33.33,118.54 35.11,118.54 41.08,119.05 41.21,116.38 34.48,114.22 38.41,114.48 37.4,115.49 20.9,117.79 20.9,116.26 26.75,113.34 36.4,53.27 37.92,53.27 34.24,53.27 6.59,34.55 8.12,34.55 9.9,34.55 11.8,34.55 6.59,32.78 8.12,32.78 9.9,32.78 11.8,32.65 19.55,34.43 2.15,37.35 59.04,24.01 60.7,24.01 62.35,24.01 59.04,22.11 60.7,22.11 62.35,22.11 63.74,22.11 11.26,104.79 9.1,105.04 6.94,105.04 4.52,105.04 3.89,107.97 6.43,107.97 9.48,107.71 23.96,106.44 25.48,104.79 29.04,96.54 31.07,96.54 30.05,97.68 18.49,84.98 18.62,88.92 22.18,84.98 22.94,90.06 23.07,82.57 26.75,81.42 25.23,79.26 29.04,79.52 29.92,87.52 31.58,91.71 33.48,89.17 35,94.5 29.8,90.19 24.59,93.87 30.94,109.36 27.51,112.45 28.4,111.56 16.26,120.54 16.06,129.33 17.46,129.33 18.73,129.33 22.41,129.21 14.79,131.37 15.93,131.37 16.95,131.37 20.38,131.37 21.52,131.37 22.79,131.37 24.19,131.37 27.62,131.49 29.14,131.37 30.03,130.6 31.05,129.72 31.81,128.95 32.19,127.81 5.27,149.02 6.03,145.34 12.12,149.15 19.49,149.4 27.36,149.27 29.14,145.08 33.71,148.64 21.39,145.84 21.27,139.24 21.27,135.18 22.92,137.34 31.17,138.1 29.27,133.91 29.4,141.15 7.68,134.29 6.79,140.89 24.95,148.51 15.43,150.67 26.09,117.52 25.71,119.68